# Altium schematic sheet v6_power.SchDoc: Virtex-6 Power Input
size A3; Date: DO NOT USE, RATHER USE PROJ OPTIONS; DrawnBy: DO NOT USE, RATHER USE PROJ OPTIONS; Engineer: DO NOT USE, RATHER USE PROJ OPTIONS; Organization: DO NOT USE, RATHER USE PROJ OPTIONS; DocumentNumber: DO NOT USE, RATHER USE PROJ OPTIONS; Revision: DO NOT USE, RATHER USE PROJ OPTIONS; SheetNumber: 12; SheetTotal: 27; SCH_Sheet_Filename: v6_power.SchDoc; CurrentTime: DO NOT USE, RATHER USE PROJ OPTIONS; Time: DO NOT USE, RATHER USE PROJ OPTIONS; DocumentFullPathAndName: DO NOT USE, RATHER USE PROJ OPTIONS; DocumentName: DO NOT USE, RATHER USE PROJ OPTIONS; ModifiedDate: DO NOT USE, RATHER USE PROJ OPTIONS; ImagePath: DO NOT USE, RATHER USE PROJ OPTIONS
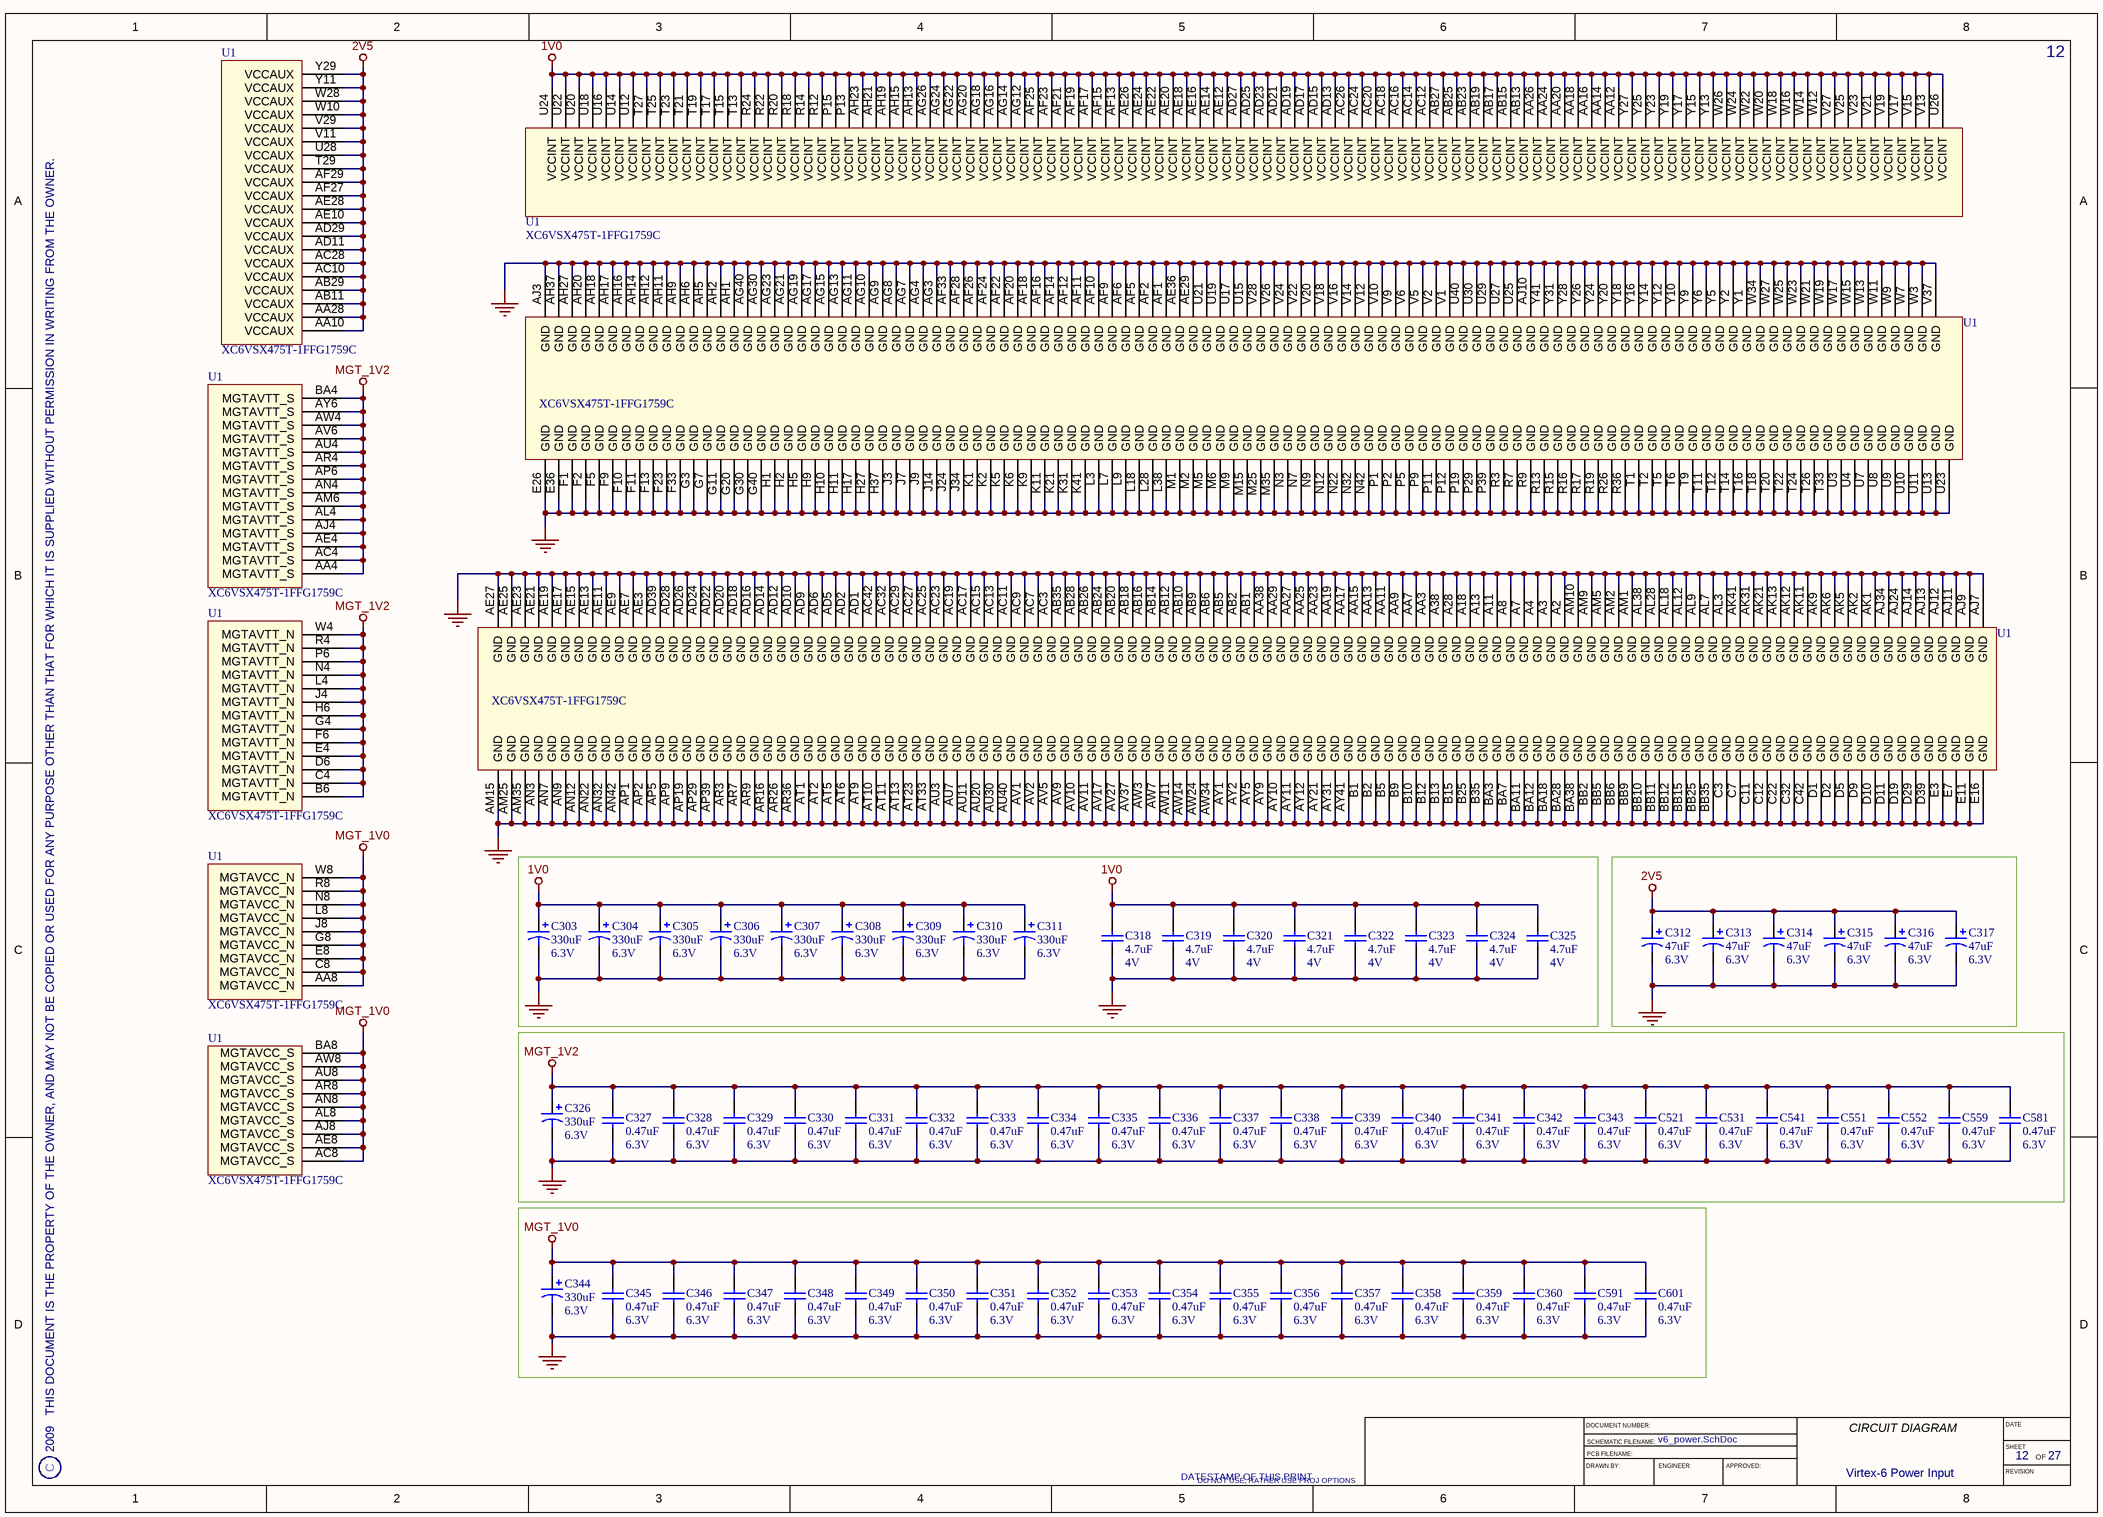
[diagram p0: v6_power.SchDoc]

## Parts
C303  Rating: 6.3V  [CAPMP7343X280L]  (hidden comment: 330uF)
C304  Rating: 6.3V  [CAPMP7343X280L]  (hidden comment: 330uF)
C305  Rating: 6.3V  [CAPMP7343X280L]  (hidden comment: 330uF)
C306  Rating: 6.3V  [CAPMP7343X280L]  (hidden comment: 330uF)
C307  Rating: 6.3V  [CAPMP7343X280L]  (hidden comment: 330uF)
C308  Rating: 6.3V  [CAPMP7343X280L]  (hidden comment: 330uF)
C309  Rating: 6.3V  [CAPMP7343X280L]  (hidden comment: 330uF)
C310  Rating: 6.3V  [CAPMP7343X280L]  (hidden comment: 330uF)
C311  Rating: 6.3V  [CAPMP7343X280L]  (hidden comment: 330uF)
C312  Rating: 6.3V  [CAPMP3528X120L]  (hidden comment: 47uF)
C313  Rating: 6.3V  [CAPMP3528X120L]  (hidden comment: 47uF)
C314  Rating: 6.3V  [CAPMP3528X120L]  (hidden comment: 47uF)
C315  Rating: 6.3V  [CAPMP3528X120L]  (hidden comment: 47uF)
C316  Rating: 6.3V  [CAPMP3528X120L]  (hidden comment: 47uF)
C317  Rating: 6.3V  [CAPMP3528X120L]  (hidden comment: 47uF)
C318  Rating: 4V  [CAPC1005X60L]  (hidden comment: 4.7uF)
C319  Rating: 4V  [CAPC1005X60L]  (hidden comment: 4.7uF)
C320  Rating: 4V  [CAPC1005X60L]  (hidden comment: 4.7uF)
C321  Rating: 4V  [CAPC1005X60L]  (hidden comment: 4.7uF)
C322  Rating: 4V  [CAPC1005X60L]  (hidden comment: 4.7uF)
C323  Rating: 4V  [CAPC1005X60L]  (hidden comment: 4.7uF)
C324  Rating: 4V  [CAPC1005X60L]  (hidden comment: 4.7uF)
C325  Rating: 4V  [CAPC1005X60L]  (hidden comment: 4.7uF)
C326  Rating: 6.3V  [CAPMP7343X280L]  (hidden comment: 330uF)
C327  Rating: 6.3V  [CAPC1005X55L]  (hidden comment: 0.47uF)
C328  Rating: 6.3V  [CAPC1005X55L]  (hidden comment: 0.47uF)
C329  Rating: 6.3V  [CAPC1005X55L]  (hidden comment: 0.47uF)
C330  Rating: 6.3V  [CAPC1005X55L]  (hidden comment: 0.47uF)
C331  Rating: 6.3V  [CAPC1005X55L]  (hidden comment: 0.47uF)
C332  Rating: 6.3V  [CAPC1005X55L]  (hidden comment: 0.47uF)
C333  Rating: 6.3V  [CAPC1005X55L]  (hidden comment: 0.47uF)
C334  Rating: 6.3V  [CAPC1005X55L]  (hidden comment: 0.47uF)
C335  Rating: 6.3V  [CAPC1005X55L]  (hidden comment: 0.47uF)
C336  Rating: 6.3V  [CAPC1005X55L]  (hidden comment: 0.47uF)
C337  Rating: 6.3V  [CAPC1005X55L]  (hidden comment: 0.47uF)
C338  Rating: 6.3V  [CAPC1005X55L]  (hidden comment: 0.47uF)
C339  Rating: 6.3V  [CAPC1005X55L]  (hidden comment: 0.47uF)
C340  Rating: 6.3V  [CAPC1005X55L]  (hidden comment: 0.47uF)
C341  Rating: 6.3V  [CAPC1005X55L]  (hidden comment: 0.47uF)
C342  Rating: 6.3V  [CAPC1005X55L]  (hidden comment: 0.47uF)
C343  Rating: 6.3V  [CAPC1005X55L]  (hidden comment: 0.47uF)
C344  Rating: 6.3V  [CAPMP7343X280L]  (hidden comment: 330uF)
C345  Rating: 6.3V  [CAPC1005X55L]  (hidden comment: 0.47uF)
C346  Rating: 6.3V  [CAPC1005X55L]  (hidden comment: 0.47uF)
C347  Rating: 6.3V  [CAPC1005X55L]  (hidden comment: 0.47uF)
C348  Rating: 6.3V  [CAPC1005X55L]  (hidden comment: 0.47uF)
C349  Rating: 6.3V  [CAPC1005X55L]  (hidden comment: 0.47uF)
C350  Rating: 6.3V  [CAPC1005X55L]  (hidden comment: 0.47uF)
C351  Rating: 6.3V  [CAPC1005X55L]  (hidden comment: 0.47uF)
C352  Rating: 6.3V  [CAPC1005X55L]  (hidden comment: 0.47uF)
C353  Rating: 6.3V  [CAPC1005X55L]  (hidden comment: 0.47uF)
C354  Rating: 6.3V  [CAPC1005X55L]  (hidden comment: 0.47uF)
C355  Rating: 6.3V  [CAPC1005X55L]  (hidden comment: 0.47uF)
C356  Rating: 6.3V  [CAPC1005X55L]  (hidden comment: 0.47uF)
C357  Rating: 6.3V  [CAPC1005X55L]  (hidden comment: 0.47uF)
C358  Rating: 6.3V  [CAPC1005X55L]  (hidden comment: 0.47uF)
C359  Rating: 6.3V  [CAPC1005X55L]  (hidden comment: 0.47uF)
C360  Rating: 6.3V  [CAPC1005X55L]  (hidden comment: 0.47uF)
C521  Rating: 6.3V  [CAPC1005X55L]  (hidden comment: 0.47uF)
C531  Rating: 6.3V  [CAPC1005X55L]  (hidden comment: 0.47uF)
C541  Rating: 6.3V  [CAPC1005X55L]  (hidden comment: 0.47uF)
C551  Rating: 6.3V  [CAPC1005X55L]  (hidden comment: 0.47uF)
C552  Rating: 6.3V  [CAPC1005X55L]  (hidden comment: 0.47uF)
C559  Rating: 6.3V  [CAPC1005X55L]  (hidden comment: 0.47uF)
C581  Rating: 6.3V  [CAPC1005X55L]  (hidden comment: 0.47uF)
C591  Rating: 6.3V  [CAPC1005X55L]  (hidden comment: 0.47uF)
C601  Rating: 6.3V  [CAPC1005X55L]  (hidden comment: 0.47uF)
U1  XC6VSX475T-1FFG1759C  [FFG1759]  (parts 32,33,34,35,36,37,38,39 of 39)

## Nets
1V0: C303.1 C304.1 C305.1 C306.1 C307.1 C308.1 C309.1 C310.1 C311.1 C318.2 C319.2 C320.2 C321.2 C322.2 C323.2 C324.2 C325.2 U1.AA12(VCCINT) U1.AA14(VCCINT) U1.AA16(VCCINT) U1.AA18(VCCINT) U1.AA20(VCCINT) U1.AA24(VCCINT) U1.AA26(VCCINT) U1.AB13(VCCINT) U1.AB15(VCCINT) U1.AB17(VCCINT) U1.AB19(VCCINT) U1.AB23(VCCINT) U1.AB25(VCCINT) U1.AB27(VCCINT) U1.AC12(VCCINT) U1.AC14(VCCINT) U1.AC16(VCCINT) U1.AC18(VCCINT) U1.AC20(VCCINT) U1.AC24(VCCINT) U1.AC26(VCCINT) U1.AD13(VCCINT) U1.AD15(VCCINT) U1.AD17(VCCINT) U1.AD19(VCCINT) U1.AD21(VCCINT) U1.AD23(VCCINT) U1.AD25(VCCINT) U1.AD27(VCCINT) U1.AE12(VCCINT) U1.AE14(VCCINT) U1.AE16(VCCINT) U1.AE18(VCCINT) U1.AE20(VCCINT) U1.AE22(VCCINT) U1.AE24(VCCINT) U1.AE26(VCCINT) U1.AF13(VCCINT) U1.AF15(VCCINT) U1.AF17(VCCINT) U1.AF19(VCCINT) U1.AF21(VCCINT) U1.AF23(VCCINT) U1.AF25(VCCINT) U1.AG12(VCCINT) U1.AG14(VCCINT) U1.AG16(VCCINT) U1.AG18(VCCINT) U1.AG20(VCCINT) U1.AG22(VCCINT) U1.AG24(VCCINT) U1.AG26(VCCINT) U1.AH13(VCCINT) U1.AH15(VCCINT) U1.AH19(VCCINT) U1.AH21(VCCINT) U1.AH23(VCCINT) U1.P13(VCCINT) U1.P15(VCCINT) U1.R12(VCCINT) U1.R14(VCCINT) U1.R18(VCCINT) U1.R20(VCCINT) U1.R22(VCCINT) U1.R24(VCCINT) U1.T13(VCCINT) U1.T15(VCCINT) U1.T17(VCCINT) U1.T19(VCCINT) U1.T21(VCCINT) U1.T23(VCCINT) U1.T25(VCCINT) U1.T27(VCCINT) U1.U12(VCCINT) U1.U14(VCCINT) U1.U16(VCCINT) U1.U18(VCCINT) U1.U20(VCCINT) U1.U22(VCCINT) U1.U24(VCCINT) U1.U26(VCCINT) U1.V13(VCCINT) U1.V15(VCCINT) U1.V17(VCCINT) U1.V19(VCCINT) U1.V21(VCCINT) U1.V23(VCCINT) U1.V25(VCCINT) U1.V27(VCCINT) U1.W12(VCCINT) U1.W14(VCCINT) U1.W16(VCCINT) U1.W18(VCCINT) U1.W20(VCCINT) U1.W22(VCCINT) U1.W24(VCCINT) U1.W26(VCCINT) U1.Y13(VCCINT) U1.Y15(VCCINT) U1.Y17(VCCINT) U1.Y19(VCCINT) U1.Y23(VCCINT) U1.Y25(VCCINT) U1.Y27(VCCINT)
2V5: C312.1 C313.1 C314.1 C315.1 C316.1 C317.1 U1.AA10(VCCAUX) U1.AA28(VCCAUX) U1.AB11(VCCAUX) U1.AB29(VCCAUX) U1.AC10(VCCAUX) U1.AC28(VCCAUX) U1.AD11(VCCAUX) U1.AD29(VCCAUX) U1.AE10(VCCAUX) U1.AE28(VCCAUX) U1.AF27(VCCAUX) U1.AF29(VCCAUX) U1.T29(VCCAUX) U1.U28(VCCAUX) U1.V11(VCCAUX) U1.V29(VCCAUX) U1.W10(VCCAUX) U1.W28(VCCAUX) U1.Y11(VCCAUX) U1.Y29(VCCAUX)
GND: C303.2 C304.2 C305.2 C306.2 C307.2 C308.2 C309.2 C310.2 C311.2 C312.2 C313.2 C314.2 C315.2 C316.2 C317.2 C318.1 C319.1 C320.1 C321.1 C322.1 C323.1 C324.1 C325.1 C326.2 C327.1 C328.1 C329.1 C330.1 C331.1 C332.1 C333.1 C334.1 C335.1 C336.1 C337.1 C338.1 C339.1 C340.1 C341.1 C342.1 C343.1 C344.2 C345.1 C346.1 C347.1 C348.1 C349.1 C350.1 C351.1 C352.1 C353.1 C354.1 C355.1 C356.1 C357.1 C358.1 C359.1 C360.1 C521.1 C531.1 C541.1 C551.1 C552.1 C559.1 C581.1 C591.1 C601.1 U1.A2(GND) U1.A3(GND) U1.A4(GND) U1.A7(GND) U1.A8(GND) U1.A11(GND) U1.A13(GND) U1.A18(GND) U1.A28(GND) U1.A38(GND) U1.AA3(GND) U1.AA7(GND) U1.AA9(GND) U1.AA11(GND) U1.AA13(GND) U1.AA15(GND) U1.AA17(GND) U1.AA19(GND) U1.AA23(GND) U1.AA25(GND) U1.AA27(GND) U1.AA29(GND) U1.AA38(GND) U1.AB1(GND) U1.AB2(GND) U1.AB5(GND) U1.AB6(GND) U1.AB9(GND) U1.AB10(GND) U1.AB12(GND) U1.AB14(GND) U1.AB16(GND) U1.AB18(GND) U1.AB20(GND) U1.AB24(GND) U1.AB26(GND) U1.AB28(GND) U1.AB35(GND) U1.AC3(GND) U1.AC7(GND) U1.AC9(GND) U1.AC11(GND) U1.AC13(GND) U1.AC15(GND) U1.AC17(GND) U1.AC19(GND) U1.AC23(GND) U1.AC25(GND) U1.AC27(GND) U1.AC29(GND) U1.AC32(GND) U1.AC42(GND) U1.AD1(GND) U1.AD2(GND) U1.AD5(GND) U1.AD6(GND) U1.AD9(GND) U1.AD10(GND) U1.AD12(GND) U1.AD14(GND) U1.AD16(GND) U1.AD18(GND) U1.AD20(GND) U1.AD22(GND) U1.AD24(GND) U1.AD26(GND) U1.AD28(GND) U1.AD39(GND) U1.AE3(GND) U1.AE7(GND) U1.AE9(GND) U1.AE11(GND) U1.AE13(GND) U1.AE15(GND) U1.AE17(GND) U1.AE19(GND) U1.AE21(GND) U1.AE23(GND) U1.AE25(GND) U1.AE27(GND) U1.AE29(GND) U1.AE36(GND) U1.AF1(GND) U1.AF2(GND) U1.AF5(GND) U1.AF6(GND) U1.AF9(GND) U1.AF10(GND) U1.AF11(GND) U1.AF12(GND) U1.AF14(GND) U1.AF16(GND) U1.AF18(GND) U1.AF20(GND) U1.AF22(GND) U1.AF24(GND) U1.AF26(GND) U1.AF28(GND) U1.AF33(GND) U1.AG3(GND) U1.AG4(GND) U1.AG7(GND) U1.AG8(GND) U1.AG9(GND) U1.AG10(GND) U1.AG11(GND) U1.AG13(GND) U1.AG15(GND) U1.AG17(GND) U1.AG19(GND) U1.AG21(GND) U1.AG23(GND) U1.AG30(GND) U1.AG40(GND) U1.AH1(GND) U1.AH2(GND) U1.AH5(GND) U1.AH6(GND) U1.AH9(GND) U1.AH11(GND) U1.AH12(GND) U1.AH14(GND) U1.AH16(GND) U1.AH17(GND) U1.AH18(GND) U1.AH20(GND) U1.AH27(GND) U1.AH37(GND) U1.AJ3(GND) U1.AJ7(GND) U1.AJ9(GND) U1.AJ10(GND) U1.AJ11(GND) U1.AJ12(GND) U1.AJ13(GND) U1.AJ14(GND) U1.AJ24(GND) U1.AJ34(GND) U1.AK1(GND) U1.AK2(GND) U1.AK5(GND) U1.AK6(GND) U1.AK9(GND) U1.AK11(GND) U1.AK12(GND) U1.AK13(GND) U1.AK21(GND) U1.AK31(GND) U1.AK41(GND) U1.AL3(GND) U1.AL7(GND) U1.AL9(GND) U1.AL12(GND) U1.AL18(GND) U1.AL28(GND) U1.AL38(GND) U1.AM1(GND) U1.AM2(GND) U1.AM5(GND) U1.AM9(GND) U1.AM10(GND) U1.AM15(GND) U1.AM25(GND) U1.AM35(GND) U1.AN3(GND) U1.AN7(GND) U1.AN9(GND) U1.AN12(GND) U1.AN22(GND) U1.AN32(GND) U1.AN42(GND) U1.AP1(GND) U1.AP2(GND) U1.AP5(GND) U1.AP9(GND) U1.AP19(GND) U1.AP29(GND) U1.AP39(GND) U1.AR3(GND) U1.AR7(GND) U1.AR9(GND) U1.AR16(GND) U1.AR26(GND) U1.AR36(GND) U1.AT1(GND) U1.AT2(GND) U1.AT5(GND) U1.AT6(GND) U1.AT9(GND) U1.AT10(GND) U1.AT11(GND) U1.AT13(GND) U1.AT23(GND) U1.AT33(GND) U1.AU3(GND) U1.AU7(GND) U1.AU11(GND) U1.AU20(GND) U1.AU30(GND) U1.AU40(GND) U1.AV1(GND) U1.AV2(GND) U1.AV5(GND) U1.AV9(GND) U1.AV10(GND) U1.AV11(GND) U1.AV17(GND) U1.AV27(GND) U1.AV37(GND) U1.AW3(GND) U1.AW7(GND) U1.AW11(GND) U1.AW14(GND) U1.AW24(GND) U1.AW34(GND) U1.AY1(GND) U1.AY2(GND) U1.AY5(GND) U1.AY9(GND) U1.AY10(GND) U1.AY11(GND) U1.AY12(GND) U1.AY21(GND) U1.AY31(GND) U1.AY41(GND) U1.B1(GND) U1.B2(GND) U1.B5(GND) U1.B9(GND) U1.B10(GND) U1.B12(GND) U1.B13(GND) U1.B15(GND) U1.B25(GND) U1.B35(GND) U1.BA3(GND) U1.BA7(GND) U1.BA11(GND) U1.BA12(GND) U1.BA18(GND) U1.BA28(GND) U1.BA38(GND) U1.BB2(GND) U1.BB5(GND) U1.BB6(GND) U1.BB9(GND) U1.BB10(GND) U1.BB11(GND) U1.BB12(GND) U1.BB15(GND) U1.BB25(GND) U1.BB35(GND) U1.C3(GND) U1.C7(GND) U1.C11(GND) U1.C12(GND) U1.C22(GND) U1.C32(GND) U1.C42(GND) U1.D1(GND) U1.D2(GND) U1.D5(GND) U1.D9(GND) U1.D10(GND) U1.D11(GND) U1.D19(GND) U1.D29(GND) U1.D39(GND) U1.E3(GND) U1.E7(GND) U1.E11(GND) U1.E16(GND) U1.E26(GND) U1.E36(GND) U1.F1(GND) U1.F2(GND) U1.F5(GND) U1.F9(GND) U1.F10(GND) U1.F11(GND) U1.F13(GND) U1.F23(GND) U1.F33(GND) U1.G3(GND) U1.G7(GND) U1.G11(GND) U1.G20(GND) U1.G30(GND) U1.G40(GND) U1.H1(GND) U1.H2(GND) U1.H5(GND) U1.H9(GND) U1.H10(GND) U1.H11(GND) U1.H17(GND) U1.H27(GND) U1.H37(GND) U1.J3(GND) U1.J7(GND) U1.J9(GND) U1.J14(GND) U1.J24(GND) U1.J34(GND) U1.K1(GND) U1.K2(GND) U1.K5(GND) U1.K6(GND) U1.K9(GND) U1.K11(GND) U1.K21(GND) U1.K31(GND) U1.K41(GND) U1.L3(GND) U1.L7(GND) U1.L9(GND) U1.L18(GND) U1.L28(GND) U1.L38(GND) U1.M1(GND) U1.M2(GND) U1.M5(GND) U1.M6(GND) U1.M9(GND) U1.M15(GND) U1.M25(GND) U1.M35(GND) U1.N3(GND) U1.N7(GND) U1.N9(GND) U1.N12(GND) U1.N22(GND) U1.N32(GND) U1.N42(GND) U1.P1(GND) U1.P2(GND) U1.P5(GND) U1.P9(GND) U1.P11(GND) U1.P12(GND) U1.P19(GND) U1.P29(GND) U1.P39(GND) U1.R3(GND) U1.R7(GND) U1.R9(GND) U1.R13(GND) U1.R15(GND) U1.R16(GND) U1.R17(GND) U1.R19(GND) U1.R26(GND) U1.R36(GND) U1.T1(GND) U1.T2(GND) U1.T5(GND) U1.T6(GND) U1.T9(GND) U1.T11(GND) U1.T12(GND) U1.T14(GND) U1.T16(GND) U1.T18(GND) U1.T20(GND) U1.T22(GND) U1.T24(GND) U1.T26(GND) U1.T33(GND) U1.U3(GND) U1.U4(GND) U1.U7(GND) U1.U8(GND) U1.U9(GND) U1.U10(GND) U1.U11(GND) U1.U13(GND) U1.U15(GND) U1.U17(GND) U1.U19(GND) U1.U21(GND) U1.U23(GND) U1.U25(GND) U1.U27(GND) U1.U29(GND) U1.U30(GND) U1.U40(GND) U1.V1(GND) U1.V2(GND) U1.V5(GND) U1.V6(GND) U1.V9(GND) U1.V10(GND) U1.V12(GND) U1.V14(GND) U1.V16(GND) U1.V18(GND) U1.V20(GND) U1.V22(GND) U1.V24(GND) U1.V26(GND) U1.V28(GND) U1.V37(GND) U1.W3(GND) U1.W7(GND) U1.W9(GND) U1.W11(GND) U1.W13(GND) U1.W15(GND) U1.W17(GND) U1.W19(GND) U1.W21(GND) U1.W23(GND) U1.W25(GND) U1.W27(GND) U1.W34(GND) U1.Y1(GND) U1.Y2(GND) U1.Y5(GND) U1.Y6(GND) U1.Y9(GND) U1.Y10(GND) U1.Y12(GND) U1.Y14(GND) U1.Y16(GND) U1.Y18(GND) U1.Y20(GND) U1.Y24(GND) U1.Y26(GND) U1.Y28(GND) U1.Y31(GND) U1.Y41(GND)
MGT_1V0: C344.1 C345.2 C346.2 C347.2 C348.2 C349.2 C350.2 C351.2 C352.2 C353.2 C354.2 C355.2 C356.2 C357.2 C358.2 C359.2 C360.2 C591.2 C601.2 U1.AA8(MGTAVCC_N) U1.AC8(MGTAVCC_S) U1.AE8(MGTAVCC_S) U1.AJ8(MGTAVCC_S) U1.AL8(MGTAVCC_S) U1.AN8(MGTAVCC_S) U1.AR8(MGTAVCC_S) U1.AU8(MGTAVCC_S) U1.AW8(MGTAVCC_S) U1.BA8(MGTAVCC_S) U1.C8(MGTAVCC_N) U1.E8(MGTAVCC_N) U1.G8(MGTAVCC_N) U1.J8(MGTAVCC_N) U1.L8(MGTAVCC_N) U1.N8(MGTAVCC_N) U1.R8(MGTAVCC_N) U1.W8(MGTAVCC_N)
MGT_1V2: C326.1 C327.2 C328.2 C329.2 C330.2 C331.2 C332.2 C333.2 C334.2 C335.2 C336.2 C337.2 C338.2 C339.2 C340.2 C341.2 C342.2 C343.2 C521.2 C531.2 C541.2 C551.2 C552.2 C559.2 C581.2 U1.AA4(MGTAVTT_S) U1.AC4(MGTAVTT_S) U1.AE4(MGTAVTT_S) U1.AJ4(MGTAVTT_S) U1.AL4(MGTAVTT_S) U1.AM6(MGTAVTT_S) U1.AN4(MGTAVTT_S) U1.AP6(MGTAVTT_S) U1.AR4(MGTAVTT_S) U1.AU4(MGTAVTT_S) U1.AV6(MGTAVTT_S) U1.AW4(MGTAVTT_S) U1.AY6(MGTAVTT_S) U1.B6(MGTAVTT_N) U1.BA4(MGTAVTT_S) U1.C4(MGTAVTT_N) U1.D6(MGTAVTT_N) U1.E4(MGTAVTT_N) U1.F6(MGTAVTT_N) U1.G4(MGTAVTT_N) U1.H6(MGTAVTT_N) U1.J4(MGTAVTT_N) U1.L4(MGTAVTT_N) U1.N4(MGTAVTT_N) U1.P6(MGTAVTT_N) U1.R4(MGTAVTT_N) U1.W4(MGTAVTT_N)

## Notes on the sheet
- 2009   THIS DOCUMENT IS THE PROPERTY OF THE OWNER, AND MAY NOT BE COPIED OR USED FOR ANY PURPOSE OTHER THAN THAT FOR WHICH IT IS SUPPLIED WITHOUT PERMISSION IN WRITING FROM THE OWNER.
- C
- DATESTAMP OF THIS PRINT
- DRAWN BY:
- DOCUMENT NUMBER:
- SCHEMATIC FILENAME:
- PCB FILENAME:
- ENGINEER:
- APPROVED:
- CIRCUIT DIAGRAM
- DATE
- SHEET
- REVISION
- OF

## Library data of the parts
C303-C311 C326 C344 = CAP-TAN-2: 330uF, Conductive Polymer Chip Capacitor; Manufacturer: KEMET; PartNum: T520D337M006ATE045; Tolerance: 20%; ESR: 0.05; POD number: CAP-TAN-2; Value: 330uF; RoHS: Y; Sort Value: 330; Category: Capacitors; Subcategory: Tantalum
C312-C317 = CAP-TAN-1: 47uF, Conductive Polymer Chip Capacitor; Manufacturer: KEMET; PartNum: T520T476M006ATE070; Tolerance: 20%; ESR: 0.07; POD number: CAP-TAN-1; Value: 47uF; RoHS: Y; Sort Value: 47; Category: Capacitors; Subcategory: Tantalum
C318-C325 = CAP-CER-11: 4.7uF, Ceramic Capacitor; Manufacturer: MURATA; PartNum: AMK105BJ475MV-F; Tolerance: 20%; Dielectric: X5R; POD number: CAP-CER-11; Value: 4.7uF; RoHS: Y; Sort Value: 4.7; Category: Capacitors; Subcategory: Ceramic
C327-C343 C345-C360 C521 C531 C541 C551 C552 C559 C581 C591 C601 = CAP-CER-7: 0.47uF, Ceramic Capacitor; Manufacturer: MURATA; PartNum: GRM155R60J474KE19; Tolerance: 10%; Dielectric: X5R; POD number: CAP-CER-7; Value: 0.47uF; RoHS: Y; Sort Value: 0.47; Category: Capacitors; Subcategory: Ceramic
U1 = IC-PLD-0: Virtex-6 475SXT 1760-pin FPGA; Manufacturer: Xilinx; POD number: IC-PLD-0; PartNum: XC6VSX475T-1FFG1759C; RoHS: Y; Category: IC; Subcategory: PLD